# EasyEDA Pro project ProPrj_Avaota A1 八核 AIoT 开发板_2024-05-20.epro, board PCB1 (continued)
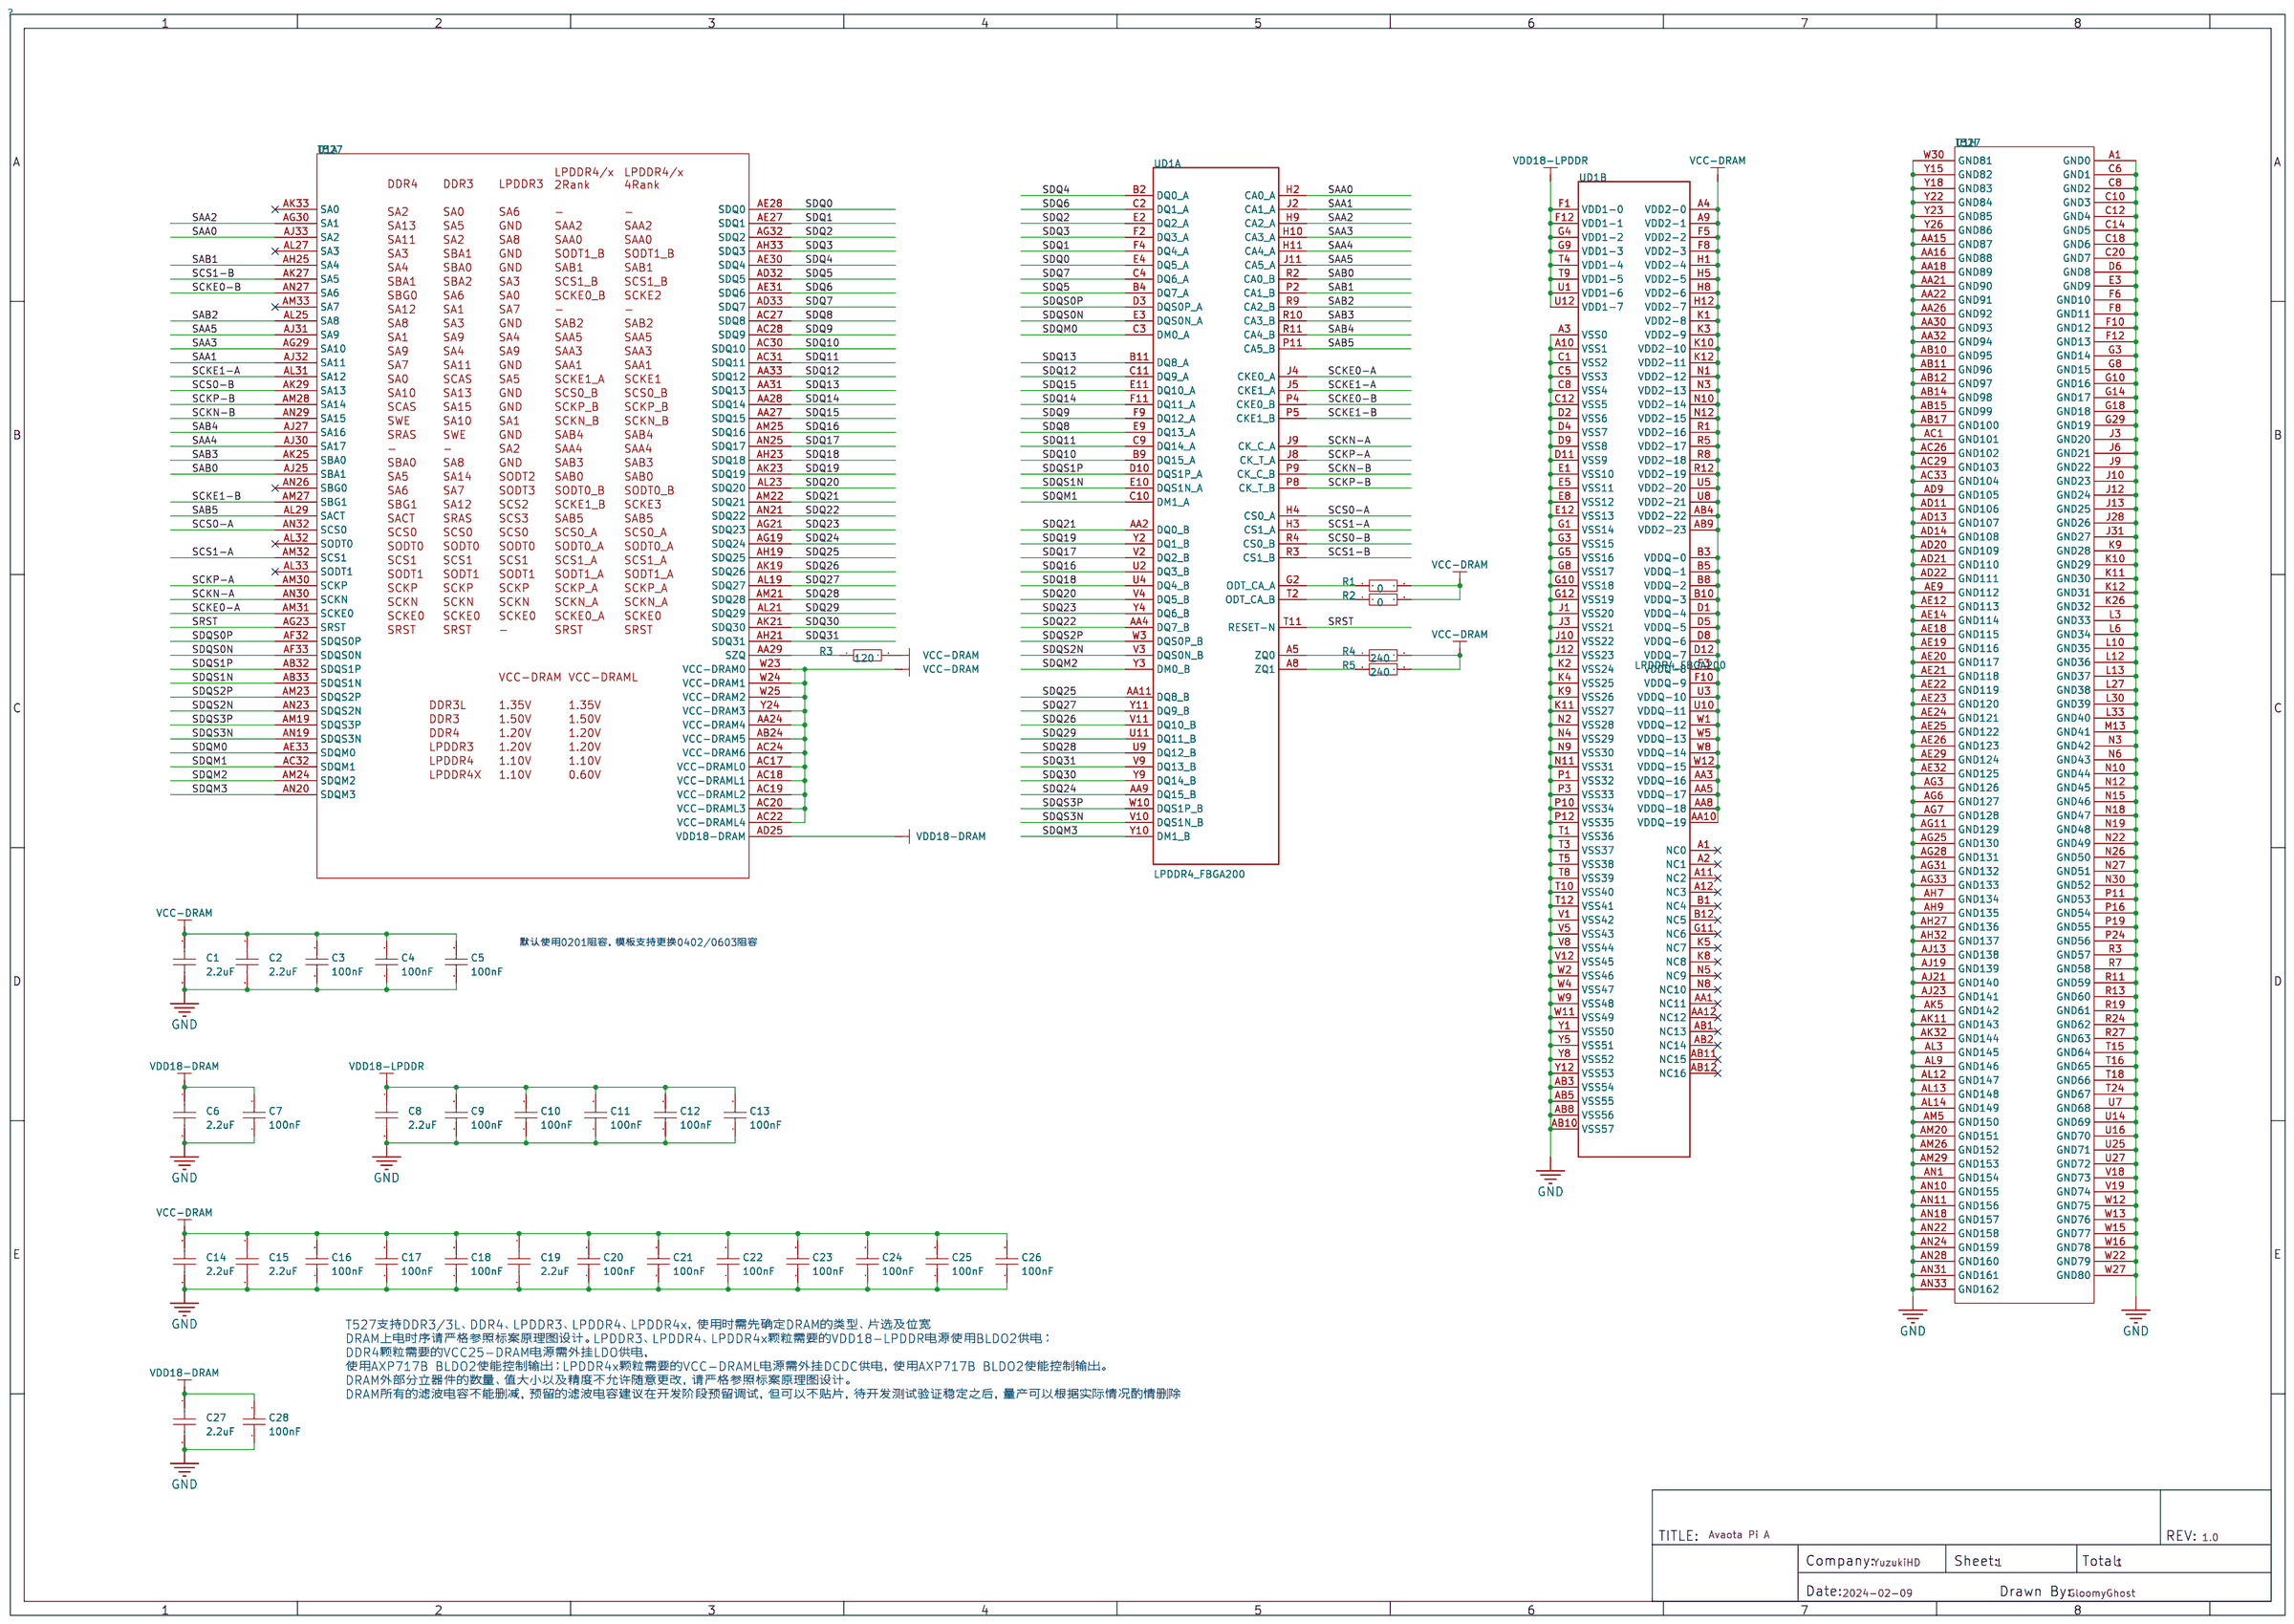
[diagram p0: schematic sheet]
## Routing (per net, layer and track width the routed paths; a pad name or vN(x,y) marks a point on that pad's centre or on a via; arc(x,y) is an arc through that point) (continued)
LCD0-RST: length 76.4
  Top Layer w0.076: 64.44,39.02 64.5,39.64 64.6,39.87 64.67,39.99 64.69,40.17 64.63,40.37 64.43,40.61
  Top Layer w0.102: v3(63.88,37.36) 63.88,38.13 64.44,38.68 64.44,39.03
  内层2 w0.127: v3(28.5,24.23) 28.5,25.81 28.09,26.21 28.09,31.9 31.27,35.08 35.99,35.08 36.3,34.77 36.3,33.83 37.85,32.28 53.47,32.28 56.26,35.08 61.01,35.08 63.3,37.36 v3(63.88,37.36)
  Bottom Layer w0.127: FPC1.33 6.79,21.78 7.42,22.4 17.86,22.4 19.68,24.23 v3(28.5,24.23)
LCD0-VSYNC: length 80.8
  Top Layer w0.127: U14.L29 v3(64.95,42.15)
  内层2 w0.127: v3(64.95,42.15) 64.61,42.15 64.36,42.39 64.36,42.73 64.07,43.03 63.7,43.03 63.32,42.65 63.32,39.4 62.86,38.94 62.86,38 60.66,35.79 55.8,35.79 53.19,33.17 42.65,33.17 41.71,34.11 40.77,34.11 40.23,33.58 39.19,33.58 38.81,33.96 38.81,34.47 38.46,34.82 37.47,34.82 36.5,35.79 30.81,35.79 27.23,32.21 27.23,26.42 26.77,25.96 26.77,24.05 25.5,22.78 24.87,22.78 23.55,21.46 v3(22.94,21.46)
  Bottom Layer w0.127: v3(22.94,21.46) 21.13,21.46 19.76,20.09 9.32,20.09 7.01,17.78 FPC1.41
LEDC: length 123.6
  Top Layer w0.076: v1(2.62,18.97) 2.62,18.97 LED2.3 ; v1(81.18,48.59) 79.2,48.59 77.39,50.39 68.69,50.39 U14.C13
  内层2 w0.076: v1(2.62,18.97) 5.61,15.98 34.26,15.98 38.86,20.57 50.09,20.57 51.26,21.74 57.12,21.74 59.64,19.23 61.87,19.23 63.3,20.65 69.19,20.65 69.8,20.04 74.52,20.04 78.13,23.65 78.13,25.22 81.69,28.78 81.69,48.08 v1(81.18,48.59)
MCSI0-CKN: length 41.4
  Top Layer w0.102: v1(71.5,52.45) 71.2,52.45 70.77,52.02 69.57,52.02 69.39,51.84 69.39,51.7 U14.A10
  Bottom Layer w0.102: FPC2.12 93.94,33.96 93.79,34.11 93.3,34.11 93.17,33.98 92.92,33.98 92.79,34.11 92.54,34.11 92.41,33.98 92.16,33.98 92.03,34.11 91.78,34.11 91.65,33.98 91.39,33.98 91.27,34.11 91.01,34.11 90.89,33.98 90.63,33.98 90.51,34.11 86.01,34.11 84.33,35.79 84.33,38.68 83.01,40.01 83.01,49.2 79.29,52.92 71.69,52.92 71.5,52.73 v1(71.5,52.45)
MCSI0-CKP: length 41.3
  Top Layer w0.102: v1(71.07,52.91) 71.07,52.61 70.68,52.22 69.49,52.22 68.94,51.67 U14.B10
  Bottom Layer w0.102: FPC2.13 93.94,34.46 93.79,34.31 86.23,34.31 84.56,35.99 84.56,38.76 83.21,40.11 83.21,49.28 79.37,53.12 71.6,53.12 71.39,52.91 v1(71.07,52.91)
MCSI0-D0N: length 42.9
  Top Layer w0.076: 71.37,51.05 70.97,50.65 U14.A12
  Top Layer w0.102: 71.37,51.05 71.55,51.23 79.12,51.23 79.73,50.62 79.73,49.25 v1(79.58,49.1)
  Bottom Layer w0.102: v1(79.58,49.1) 79.58,48.82 80.11,48.29 80.11,39.22 82.12,37.21 82.12,33.55 84.55,31.12 90.65,31.12 90.77,30.99 91.03,30.99 91.15,31.12 91.41,31.12 91.53,30.99 91.79,30.99 91.92,31.12 92.17,31.12 92.3,30.99 92.55,30.99 92.68,31.12 92.93,31.12 93.06,30.99 93.31,30.99 93.44,31.12 93.85,31.12 93.95,31.01 94.54,31.01 FPC2.6
MCSI0-D0P: length 43
  Top Layer w0.076: 71.17,51.21 70.87,50.9 69.2,50.9 U14.B12
  Top Layer w0.102: v1(80.11,49.07) 79.91,49.28 79.91,50.73 79.21,51.44 71.4,51.44 71.17,51.21
  Bottom Layer w0.102: FPC2.7 94.05,31.46 93.88,31.29 84.66,31.29 82.32,33.63 82.32,37.29 80.34,39.27 80.34,48.41 80.11,48.64 v1(80.11,49.07)
MCSI0-D1N: length 43.2
  Top Layer w0.076: 70.84,51.36 70.63,51.15 U14.B11
  Top Layer w0.102: 70.84,51.36 71.35,51.87 v1(72.09,51.87)
  Bottom Layer w0.102: FPC2.9 93.94,32.46 93.79,32.61 93.07,32.61 92.89,32.43 92.69,32.43 92.51,32.61 92.31,32.61 92.13,32.43 91.93,32.43 91.75,32.61 91.55,32.61 91.37,32.43 91.17,32.43 90.98,32.61 90.79,32.61 90.6,32.43 90.41,32.43 90.22,32.61 90.03,32.61 89.84,32.43 89.64,32.43 89.46,32.61 89.26,32.61 89.08,32.43 88.88,32.43 88.7,32.61 88.5,32.61 88.32,32.43 88.12,32.43 87.94,32.61 87.74,32.61 87.56,32.43 87.36,32.43 87.17,32.61 86.98,32.61 86.79,32.43 86.6,32.43 86.41,32.61 86.22,32.61 86.03,32.43 85.84,32.43 85.65,32.61 85,32.61 83.21,34.41 83.21,37.97 81.76,39.42 81.76,48.97 78.91,51.82 72.13,51.82 v1(72.09,51.87)
MCSI0-D1P: length 43.3
  Top Layer w0.127: U14.C11 68.43,51.13 v1(68,51.13)
  Bottom Layer w0.102: FPC2.10 93.94,32.96 93.79,32.81 85.09,32.81 83.41,34.49 83.41,38.05 81.97,39.5 81.97,49.12 79.06,52.03 72.46,52.03 72.28,52.21 71.87,52.21 70.79,51.13 v1(68,51.13)
MCSI0-D2N: length 40.8
  Top Layer w0.102: v3(66.93,51.13) 66.96,51.13 U14.E12
  Inner5 w0.102: v3(66.93,51.13) 67.51,50.55 80.35,50.55 83.34,47.57 83.34,37.61 85.34,35.61 89.72,35.61 89.87,35.46 v1(90.12,35.46)
  Bottom Layer w0.102: v1(90.12,35.46) 90.27,35.61 93.79,35.61 93.94,35.46 FPC2.15
MCSI0-D2P: length 40.8
  Top Layer w0.102: U14.D12 67.94,50.65 v3(67.46,51.13)
  Inner5 w0.102: v1(90.12,35.97) 89.87,35.97 89.72,35.81 85.42,35.81 83.54,37.69 83.54,47.65 80.43,50.76 71.85,50.76 71.72,50.89 71.47,50.89 71.34,50.76 71.09,50.76 70.96,50.89 70.7,50.89 70.58,50.76 70.32,50.76 70.2,50.89 69.94,50.89 69.82,50.76 69.56,50.76 69.44,50.89 69.18,50.89 69.05,50.76 68.8,50.76 68.67,50.89 68.42,50.89 68.29,50.76 67.63,50.76 67.46,50.93 v3(67.46,51.13)
  Bottom Layer w0.102: v1(90.12,35.97) 90.27,35.81 93.79,35.81 93.94,35.96 FPC2.16
MCSI0-D3N: length 41.1
  Top Layer w0.102: v3(67.44,52.15) 67.44,51.65 U14.E10
  Inner5 w0.102: v1(93.47,36.93) 93.21,36.93 93.05,37.09 86.09,37.09 84.71,38.47 84.71,48.18 80.98,51.92 74.12,51.92 72.64,53.39 70.43,53.39 68.57,51.53 67.85,51.53 67.61,51.77 67.61,51.97 v3(67.44,52.15)
  Bottom Layer w0.102: 94.34,37.09 93.88,37.09 93.72,36.93 v1(93.47,36.93)
MCSI0-D3P: length 41.1
  Top Layer w0.102: v3(67.94,52.15) 67.94,52.14 U14.D10
  Inner5 w0.102: v1(93.46,37.46) 93.21,37.46 93.05,37.3 86.17,37.3 84.91,38.56 84.91,48.27 81.03,52.15 74.18,52.15 72.73,53.59 70.35,53.59 69.44,52.68 69.24,52.68 69.07,52.51 69.07,52.31 68.9,52.14 68.7,52.14 68.53,51.97 68.53,51.77 68.46,51.71 67.93,51.71 67.79,51.84 67.79,51.99 v3(67.94,52.15)
  Bottom Layer w0.102: 94.34,37.3 93.88,37.3 93.72,37.46 v1(93.46,37.46)
MCSI0-MCLK: length 36.3
  Top Layer w0.152: v1(69.62,53.44) 69.44,53.62 U14.A6
  Bottom Layer w0.152: FPC2.24 94.52,40.03 84.88,40.03 84.1,40.82 84.1,49.61 79.86,53.85 70.03,53.85 v1(69.62,53.44)
MCSI0-PWDN: length 39
  Top Layer w0.076: 70.03,54.4 69.65,54.4 69.5,54.39 69.26,54.4 68.99,54.62
  Top Layer w0.102: 70.03,54.41 75.82,54.41 v1(76.28,54.86)
  Bottom Layer w0.102: FPC2.28 94.11,41.96 93.88,41.73 86.21,41.73 85.47,42.47 85.47,49.91 80.19,55.19 77.57,55.19 77.19,55.58 75.72,55.58 75.23,55.09 75.23,54.74 75.49,54.48 75.9,54.48 v1(76.28,54.86)
MCSI0-RSTN: length 35.5
  Top Layer w0.102: U14.A4 75.47,54.65 v1(75.69,54.86)
  Bottom Layer w0.102: FPC2.27 86.05,41.46 85.19,42.32 85.19,49.78 80.11,54.86 77.44,54.86 77.01,55.3 76.12,55.3 v1(75.69,54.86)
MCSI0-SCK: length 39.7
  Top Layer w0.102: U14.E8 v3(67.44,53.13)
  Inner5 w0.102: v1(93.12,38.66) 93.09,38.66 91.95,39.8 89.61,39.8 85.88,43.54 85.88,48.69 81.61,52.96 74.9,52.96 73.41,54.46 69.95,54.46 68.22,52.73 67.69,52.73 67.44,52.98 v3(67.44,53.13)
  Bottom Layer w0.102: FPC2.21 93.31,38.46 v1(93.12,38.66)
  Bottom Layer w0.152: R127.2 68.49,53.49 67.67,53.49 67.44,53.27 v3(67.44,53.13)
MCSI0-SDA: length 38.1
  Top Layer w0.102: U14.D8 v3(67.94,53.13)
  Inner5 w0.102: v1(93.14,39.24) 92.96,39.24 92.15,40.06 89.79,40.06 86.16,43.69 86.16,48.84 81.74,53.26 75.08,53.26 73.61,54.74 69.8,54.74 68.19,53.13 v3(67.94,53.13)
  Bottom Layer w0.102: v1(93.14,39.24) 93.42,38.96 FPC2.22
  Bottom Layer w0.152: R128.2 68.5,52.81 68.18,53.13 v3(67.94,53.13)
MCSI0-USER: length 36.3
  Top Layer w0.076: 70.31,54.15 70,54.15 69.75,53.9 69.19,53.9 U14.B5
  Top Layer w0.102: 70.31,54.15 76.23,54.15 v1(76.89,54.81)
  Bottom Layer w0.102: v1(76.89,54.81) 77.04,54.81 77.29,54.56 80.04,54.56 84.89,49.71 84.89,42.22 85.98,41.12 93.95,41.12 94.11,40.96 FPC2.26
MICIN3N: length 22.1
  Top Layer w0.076: 56.94,56.14 56.94,56.25 56.76,56.43 56.76,56.99 56.6,57.15 v3(56.57,57.15)
  内层2 w0.127: v3(56.57,57.15) 56.57,57.55 56.66,57.64 56.66,57.91 57.47,58.73 62.18,58.73 64.72,61.27 65.99,61.27 v1(66.12,61.39)
  Bottom Layer w0.127: C241.1 69.89,67.75 70.07,67.57 70.07,66.79 70.41,66.45 70.41,64.64 68.66,62.89 67.79,62.89 66.29,61.39 v1(66.12,61.39)
MICIN3P: length 22.7
  Top Layer w0.076: 57.1,57.23 v3(57.1,57.22) 56.94,57.06 56.94,56.53 57.19,56.28 57.19,55.89 56.94,55.64
  内层2 w0.127: v1(66.12,60.76) 65.91,60.96 64.92,60.96 62.33,58.37 57.61,58.37 57.01,57.77 57.01,57.64 57.1,57.55 v3(57.1,57.22)
  Bottom Layer w0.127: C238.1 70.48,67.75 70.3,67.57 70.3,66.88 70.64,66.55 70.64,64.55 68.65,62.56 67.92,62.56 v1(66.12,60.76)
PE0: length 58
  Top Layer w0.102: U14.E6 67.94,54.15 v3(67.94,54.15)
  Inner5 w0.102: H1.12 21.89,71.93 21.89,69.82 23.29,68.43 26.11,68.43 27.86,66.68 53.06,66.68 57.71,62.03 59.61,62.03 63.93,57.71 63.93,57.1 65.53,55.5 67.11,55.5 67.29,55.31 67.29,54.6 67.74,54.15 v3(67.94,54.15)
PE1: length 50.3
  Top Layer w0.076: 70.48,55.04 70.34,54.89 68.69,54.9 68.44,54.64
  Top Layer w0.102: 70.48,55.04 72.64,57.2 v3(72.67,57.2)
  VCC w0.102: 33.3,70.69 33.32,70.69 37.49,66.52 52.5,66.52 57.05,61.98 61.29,61.98 64.8,58.47 66.19,58.47 67.18,57.48 71.12,57.48 71.22,57.58 72.29,57.58 v3(72.67,57.2)
PE2: length 52.9
  Top Layer w0.102: U14.E5 v3(67.95,54.65)
  Inner5 w0.102: 23.14,70.69 25.04,68.78 26.24,68.78 27.99,67.03 53.26,67.03 57.94,62.36 59.77,62.36 64.26,57.86 64.26,57.25 65.68,55.83 67.23,55.83 67.59,55.47 67.59,54.87 67.78,54.68 67.93,54.68 v3(67.95,54.65)
PE3: length 55.1
  Top Layer w0.102: U14.E4 v3(67.95,55.15)
  Inner5 w0.102: v3(67.95,55.15) 67.95,55.65 67.44,56.16 65.76,56.16 64.59,57.33 64.59,58.12 60.02,62.69 58.14,62.69 53.47,67.36 28.19,67.36 26.39,69.16 25.04,69.16 24.46,69.75 24.46,72.16 24.88,72.58 25.03,72.58 H1.16
PE4: length 56.9
  Top Layer w0.076: 70.43,57.76 70.24,57.76 69.18,56.71 69.18,56 69.08,55.89 68.84,55.89 68.69,55.75 68.69,55.39 68.44,55.14
  Top Layer w0.102: v3(71.5,58.6) 71.5,58.57 70.69,57.76 70.43,57.76
  Inner5 w0.102: v3(71.5,58.6) 70.51,57.61 65.71,57.61 59.51,63.81 57.53,63.81 53.64,67.69 28.45,67.69 25.68,70.46 25.68,70.69
PE5: length 52.3
  Top Layer w0.076: 70.08,55.5 69.97,55.4 69.19,55.4 68.94,55.14
  Top Layer w0.102: 70.08,55.5 71.58,57 v3(71.58,57.2)
  VCC w0.102: H1.22 33.3,73.15 32.03,71.88 32.03,69.98 35.81,66.19 52.3,66.19 56.85,61.65 61.11,61.65 64.62,58.14 66.01,58.14 67.01,57.15 71.53,57.15 v3(71.58,57.2)
PE6: length 50.9
  Top Layer w0.076: 70.15,55.14 69.44,55.14
  Top Layer w0.102: v3(72.14,57.2) 72.14,57.12 70.15,55.14
  VCC w0.102: 30.76,70.69 30.76,70.64 35.53,65.86 52.17,65.86 56.77,61.27 60.96,61.27 64.36,57.86 65.84,57.86 66.88,56.82 71.81,56.82 72.14,57.15 v3(72.14,57.2)
PE7: length 52
  Top Layer w0.102: U14.A2 69.82,55.65 71.22,57.05 71.22,57.4 71.78,57.96 71.96,57.96 v3(72.62,58.62)
  VCC w0.102: v3(72.62,58.62) 72.62,58.34 72.11,57.84 71.07,57.84 71.02,57.79 67.36,57.79 66.37,58.78 65,58.78 61.47,62.31 57.2,62.31 52.65,66.85 37.69,66.85 34.62,69.93 34.62,72.03 35.81,73.23 H1.24
PE8: length 46.5
  Top Layer w0.076: 68.94,55.64 69.07,55.64 69.31,55.89 69.65,55.89 70,56.24
  Top Layer w0.102: 70,56.24 70.89,57.12 70.89,57.48 71.68,58.27 71.82,58.27 72.06,58.51 v3(72.06,58.6)
  VCC w0.102: v3(72.06,58.6) 71.55,58.09 67.49,58.09 66.5,59.08 65.2,59.08 61.59,62.69 57.38,62.69 52.81,67.26 38.81,67.26 35.84,70.23 35.84,70.69
PE9: length 56.6
  Top Layer w0.102: v3(70.94,58.6) 70.94,58.52 70.46,58.04 70.21,58.04 68.94,56.77 68.94,56.14
  Inner5 w0.102: v3(70.94,58.6) 70.23,57.89 66.07,57.89 59.72,64.24 57.63,64.24 53.85,68.02 28.63,68.02 26.97,69.67 26.97,71.93 28.22,73.18 H1.18
PE10: length 39.4
  Top Layer w0.076: 68.44,55.64 68.44,55.76 68.69,56.01 68.69,56.8 68.83,56.94
  Top Layer w0.115: 68.83,56.94 68.83,57.22 69.91,58.29 70.07,58.29 70.37,58.6 v3(70.41,58.6)
  Inner5 w0.102: 40.92,70.69 43.26,68.35 54.81,68.35 58.06,65.1 59.49,65.1 60.22,64.36 61.32,64.36 61.52,64.16 61.52,62.97 66.32,58.17 69.98,58.17 v3(70.41,58.6)
PE11: length 59.8
  Top Layer w0.102: v3(65.95,53.15) U14.J7
  Inner5 w0.102: 15.52,70.69 18.52,67.69 25.81,67.69 27.48,66.01 52.58,66.01 57.2,61.39 59.23,61.39 60.55,60.07 60.55,58.37 61.37,57.56 62.59,57.56 65.35,54.79 65.35,53.7 65.91,53.15 v3(65.95,53.15)
PE12: length 44.7
  Top Layer w0.102: U14.C1 68.5,56.21 68.5,57.33 v3(69.8,58.62)
  VCC w0.102: H1.26 37.13,71.98 37.13,69.39 38.86,67.67 52.96,67.67 56.79,63.83 58.95,63.83 59.72,63.07 61.77,63.07 65.41,59.44 66.67,59.44 67.72,58.39 69.57,58.39 v3(69.8,58.62)
PE13: length 55.2
  Top Layer w0.254: U14.G6 v3(66.95,54.15)
  Inner5 w0.102: v3(66.95,54.15) 66.57,54.15 66.42,54.31 66.42,54.76 66.09,55.09 65.48,55.09 62.69,57.89 61.54,57.89 60.86,58.57 60.86,60.25 59.44,61.67 57.45,61.67 52.78,66.35 27.69,66.35 25.96,68.07 23.09,68.07 20.6,70.56 20.6,70.69
PE14: length 61.7
  Top Layer w0.102: v3(64.95,53.15) U14.L7
  Inner5 w0.102: 12.98,70.69 16.36,67.31 25.63,67.31 27.25,65.68 52.41,65.68 57.01,61.09 59.06,61.09 60.25,59.89 60.25,58.17 61.16,57.25 62.48,57.25 64.31,55.42 64.31,54.33 64.57,54.08 64.57,53.53 v3(64.95,53.15)
PE15: length 63.1
  Top Layer w0.102: v3(63.95,53.15) U14.N7
  Inner5 w0.102: 10.44,70.69 10.44,70.36 13.84,66.95 25.43,66.95 27,65.38 45.03,65.38 49.63,60.78 55.68,60.78 56.29,60.17 57.73,60.17 61.52,56.39 62.86,56.39 63.96,55.3 63.96,54.28 64.31,53.92 64.31,53.34 64.12,53.15 v3(63.95,53.15)
PGAOUT0: length 6.5
  Top Layer w0.152: v3(61.95,52.65) 61.45,52.65 U14.U8
  Bottom Layer w0.076: v3(61.95,52.65) 62.56,53.26
  Bottom Layer w0.152: R26.1 60.71,56.24 60.86,56.39 62.18,56.39 62.59,55.98 62.59,53.29 62.56,53.26
PGAOUT1: length 4
  Bottom Layer w0.152: v3(61.44,51.65) 61.44,54.89 61.76,55.21 R27.1
PHYRSTB0: length 46.9
  Top Layer w0.127: U12.12 v3(70.39,21.03) 70.93,21.03 R90.2 ; U14.D16 v3(67.94,49.15)
  内层2 w0.102: v3(67.94,49.15) 69.32,49.15 70.05,49.89 72.42,49.89 72.8,50.27 74.63,50.27 74.88,50.01 76.45,50.01 79.45,47.02 79.45,29.46 73.58,23.6 73.58,21.64 72.97,21.03 72.01,21.03 72.01,21.03 v3(70.39,21.03)
PHYRSTB1: length 71.3
  Top Layer w0.102: v3(89.53,51.23) 89.53,51.26 88.62,52.17 88.47,52.17 88.04,52.6 88.04,57.99 83.85,62.18 68.41,62.18 65.94,59.71 65.94,57.3 65.58,56.95 65.58,56.29 U14.J1
  Top Layer w0.152: U13.12 88.99,20.89 R108.2
  内层2 w0.102: v3(89.53,51.23) 89.28,50.98 89.28,28.98 90.07,28.19 90.07,26.7 91.52,25.25 91.52,24.33 90.6,23.42 90.27,23.42 89.99,23.14 89.99,22.66 90.14,22.5 90.14,21.64 89.31,20.8 v3(88.65,20.8)
PMU-SCK: length 72.4
  Top Layer w0.102: U14.AN6 53.34,53.75 52.53,53.75 51.49,54.79 51.49,55.6 50.39,56.69 v1(37.36,56.69)
  Top Layer w0.152: v3(12.32,45.31) 12.75,44.88 13.03,44.88 13.13,44.98 14.78,44.98 15.09,44.68 15.09,44.06 U5.6 ; U4.52 5.51,49.43 v3(5.16,49.07) 5.18,49.05 R11.2
  Bottom Layer w0.102: v1(37.36,56.69) 36.55,56.69 35.86,56.01 14.4,56.01 12.47,54.08 12.47,50.06 11.1,48.69 6.26,48.69 5.65,49.3 5.38,49.3 v3(5.16,49.07) 5.16,48.9 5.82,48.23 5.82,46.05 6.93,44.93 11.94,44.93 v3(12.32,45.31)
PMU-SDA: length 75.2
  Top Layer w0.076: 53.43,54.14 53.44,54.14
  Top Layer w0.102: U4.51 5.77,49.81 6.17,49.81 6.25,49.73 6.25,49.4 5.71,48.86 R12.2 ; v1(36.75,57.07) 37.57,57.07 37.72,56.92 50.52,56.92 51.71,55.73 51.71,54.86 52.63,53.95 53.25,53.95 53.43,54.14 U14.AN5
  Top Layer w0.152: v3(12.85,45.31) 12.9,45.26 14.88,45.26 15.45,44.7 U5.5 ; v3(5.13,49.61) 5.35,49.83 U4.51
  Bottom Layer w0.102: v3(12.85,45.31) 12.24,44.7 6.78,44.7 5.56,45.92 5.56,48.16 4.8,48.92 4.8,49.28 v3(5.13,49.61) 5.71,49.61 6.35,48.97 10.97,48.97 12.24,50.24 12.24,55.04 13.51,56.31 35.66,56.31 36.42,57.07 v1(36.75,57.07)
PS: length 26.6
  Top Layer w0.203: v3(10.95,54) 11.12,53.83 U4.25 11.92,53.83 12.6,54.51 C12.1 ; v3(18.19,41.81) 18.19,42.47 18.04,42.61 U5.17 ; v3(17.65,44.17) 17.66,44.16 U5.20 ; v3(9.32,54.15) 9.46,54.3 U4.31 ; v3(9.58,49.53) 9.46,49.42 U4.9 ; v3(8.99,55.22) 9.06,55.15 U4.32 9.06,54.43 v3(8.79,54.15) ; U5.2 16.65,44.96 v3(16.79,45.1) ; v3(10.95,52.02) 11.14,51.83 U4.20 12.85,51.83 C17.1 ; C55.1 12.47,48.97 12.17,49.28 12.17,49.63 11.97,49.83 U4.15 11.21,49.83 v3(11.02,50.01)
  Top Layer w0.406: C284.2 17.84,39.92 18.19,40.26 v3(18.19,40.85) v3(18.19,41.34) v3(18.19,41.81)
  Top Layer w0.508: C284.2 C283.2
  Bottom Layer w0.102: v3(11.02,50.01) C46.1
  Bottom Layer w0.381: 11.1,53.31 11.1,53.85 v3(10.95,54) ; v3(9.58,49.53) 9.68,49.43 C30.1 ; 11.1,52.43 11.1,52.17 v3(10.95,52.02)
  Bottom Layer w0.508: C79.2 C29.1 5.79,52.83 5.82,52.86 v3(6.38,52.86) 6.5,52.98 C26.1 ; C79.2 6.13,51.05 v3(6.38,50.81) ; C79.2 6.02,51.28 v3(6.38,51.28) ; v3(8.79,54.15) 8.79,55.13 C286.2 ; C285.2 9.32,55.28 v3(9.32,54.15) ; 11.05,51.35 10.95,51.45 v3(10.95,52.02) ; 5.89,52.38 v3(6.38,52.38)
  vias: v3(18.06,45.18)
PWRON: length 19.1
  Top Layer w0.102: v3(8.66,49.5) 8.26,49.11 U4.6 8.26,48.19 C11.1
  Top Layer w0.152: v1(23.65,48.54) 23.65,49.05 23.9,49.3 24.33,49.3 C97.2 24.36,49.33 R23.2
  内层4 w0.152: v1(23.65,48.54) 23.24,48.95 11,48.95 10.85,49.1 9.07,49.1 v3(8.66,49.5)
RF: length 3.7
  Top Layer w0.127: R72.1 C244.2 15.68,64.17 15.72,64.2
RGMII0-CLKIN: length 47.9
  Top Layer w0.076: 70.56,48.18 70.33,48.18 70.26,48.11 69.99,48.11 69.78,47.9 68.69,47.89 68.44,48.14
  Top Layer w0.102: 70.56,48.18 72.95,48.18 v3(74.04,49.28)
  Top Layer w0.127: U12.35 v3(63.35,22.63)
  内层2 w0.102: v3(63.35,22.63) 63.52,22.45 71.7,22.45 72.31,23.06 72.31,24 78.51,30.2 78.51,46.51 75.84,49.17 74.14,49.17 v3(74.04,49.28)
RGMII0-MDC: length 43.5
  Top Layer w0.076: 68.44,48.64 68.69,48.39 69.04,48.39 69.14,48.3 69.67,48.3 69.9,48.53 ; 69.9,48.53 69.9,48.54
  Top Layer w0.102: v3(72.85,49.3) 72.24,48.69 70.04,48.69 69.88,48.51 ; v3(72.42,21.49) 72.35,21.43 U12.13
  内层2 w0.102: v3(72.85,49.3) 73.2,49.66 74.24,49.66 74.47,49.43 76.05,49.43 78.82,46.66 78.82,29.97 72.72,23.88 72.72,21.79 v3(72.42,21.49)
RGMII0-MDIO: length 44.1
  Top Layer w0.076: 71.98,49 71.91,48.92 69.22,48.92 U14.B16
  Top Layer w0.102: 71.98,49 v3(72.29,49.3)
  Top Layer w0.127: v3(73.18,21.82) 72.72,21.82 72.26,22.28 71.23,22.28 70.93,21.98 R83.2 70.91,21.83 U12.14
  内层2 w0.102: v3(72.29,49.3) 72.92,49.94 74.47,49.94 74.7,49.71 76.25,49.71 79.12,46.84 79.12,29.69 73.1,23.67 73.1,21.9 v3(73.18,21.82)
RGMII0-RXCK: length 42.7
  Top Layer w0.076: v3(70.66,49.33) 70.29,49.7 69.84,49.7 69.54,49.4 69.34,49.4 69.1,49.64 68.94,49.64
  Top Layer w0.127: U12.27 66,26.35 66.19,26.54 v3(66.19,26.76)
  内层2 w0.102: v3(66.19,26.76) 66.42,26.53 66.42,25.2 67.39,24.23 70.51,24.23 77.27,30.99 77.27,45.92 75.16,48.03 71.96,48.03 v3(70.66,49.33)
RGMII0-RXCTL: length 42.2
  Top Layer w0.127: U14.D18 v3(67.94,48.15) ; v3(66.75,26.76) 66.75,26.49 66.4,26.14 U12.26
  内层2 w0.102: v3(66.75,26.76) 66.75,25.3 67.49,24.56 70.28,24.56 76.91,31.19 76.91,45.87 75.11,47.68 71.75,47.68 70.79,48.64 68.43,48.64 v3(67.94,48.15)
RGMII0-RXD0: length 41.5
  Top Layer w0.127: U12.25 66.8,25.96 67.34,26.49 v3(67.34,26.76) ; U14.E18 v3(67.44,48.15)
  内层2 w0.102: v3(67.44,48.15) 67.44,47.93 67.59,47.78 68.1,47.78 68.61,48.29 70.69,48.29 71.6,47.37 74.93,47.37 76.58,45.72 76.58,31.39 70.03,24.84 67.64,24.84 67.11,25.37 67.11,26.39 67.34,26.62 v3(67.34,26.76)
RGMII0-RXD1: length 40.5
  Top Layer w0.127: U14.F18 v3(66.94,48.15) ; U12.24 67.2,25.8 67.96,26.56 v3(67.96,26.76)
  内层2 w0.102: v3(67.96,26.76) 67.46,26.26 67.46,25.53 67.87,25.12 69.75,25.12 76.25,31.62 76.25,45.57 74.78,47.04 71.48,47.04 70.56,47.96 68.76,47.96 68.34,47.54 67.42,47.54 66.94,48.02 v3(66.94,48.15)
RGMII0-RXD2: length 48.8
  Top Layer w0.127: 67.6,24.93 67.6,25.64 68.55,26.59 v3(68.55,26.76) ; U14.D14 v3(67.94,50.15)
  内层4 w0.102: v3(67.94,50.15) 68.06,50.15 70.03,48.18 78.21,48.18 80.57,45.82 80.57,28.8 76.78,25.02 69.77,25.02 68.55,26.24 v3(68.55,26.76)
RGMII0-RXD3: length 48.1
  Top Layer w0.127: v3(69.19,26.76) 69.19,26.67 68,25.48 U12.22 ; v3(67.44,50.15) U14.E14
  内层4 w0.102: v3(69.19,26.76) 68.94,26.5 68.94,26.29 69.93,25.3 76.68,25.3 80.29,28.91 80.29,45.64 78.03,47.9 69.9,47.9 68.05,49.76 67.84,49.76 v3(67.44,50.15)
RGMII0-TXCK: length 50.4
  Top Layer w0.102: v3(66.42,50.17) 66.42,50.62 U14.G12 ; U12.20 69.57,24.23 69.82,24.49 72.29,24.49 73.03,23.75 74.7,23.75 75.26,24.31 76.45,24.31 v3(76.84,23.93)
  内层2 w0.076: v3(66.42,50.17) 66.78,50.52 68.07,50.52 68.43,50.17 68.94,50.17 69.04,50.27
  内层2 w0.102: v3(76.84,23.93) 76.84,25.17 80.44,28.78 80.44,47.52 76.99,50.98 75.41,50.98 75.16,51.23 72.42,51.23 71.91,50.72 69.49,50.72 69.04,50.27
RGMII0-TXCTL: length 48.6
  Top Layer w0.102: U12.19 69.62,23.83 69.98,24.18 72.09,24.18 72.85,23.42 74.83,23.42 75.31,23.9 v3(76.2,23.9)
  Top Layer w0.127: U14.F14 v3(66.94,50.15)
  内层2 w0.102: v3(66.94,50.15) 67.36,49.73 69.01,49.73 69.7,50.42 72.03,50.42 72.52,50.9 74.96,50.9 75.21,50.65 76.81,50.65 80.11,47.35 80.11,29.03 76.45,25.37 76.45,24.16 v3(76.2,23.9)
RGMII0-TXD0: length 47.5
  Top Layer w0.102: v3(75.62,23.5) 75.46,23.5 75.03,23.06 72.75,23.06 71.98,23.83 70.16,23.83 69.76,23.43 U12.18
  Top Layer w0.127: U14.E16 v3(67.44,49.15)
  内层2 w0.102: v3(75.62,23.5) 75.62,23.9 76.1,24.38 76.1,25.55 79.78,29.24 79.78,47.19 76.63,50.34 75.03,50.34 74.78,50.6 72.62,50.6 72.19,50.17 69.9,50.17 69.24,49.5 67.79,49.5 v3(67.44,49.15)
RGMII0-TXD1: length 39.9
  Top Layer w0.076: 70.43,48.44 70.08,48.44 69.71,48.07 69.02,48.07 68.94,48.14
  Top Layer w0.102: v3(73.46,49.3) 72.59,48.44 70.43,48.44 ; U12.17 70.07,23.03 v3(70.16,23.11)
  内层2 w0.102: v3(73.46,49.3) 73.86,48.9 75.64,48.9 78.23,46.3 78.23,30.4 71.96,24.13 71.96,23.17 71.65,22.86 70.41,22.86 v3(70.16,23.11)
RGMII0-TXD2: length 37.5
  Top Layer w0.076: v3(71.2,49.33) 70.87,49.66 70.62,49.66 70.36,49.91 69.71,49.91 69.44,49.64
  Top Layer w0.102: v3(70.97,23.34) 70.25,22.63 U12.16
  内层2 w0.102: v3(71.2,49.33) 72.19,48.34 75.29,48.34 77.6,46.03 77.6,30.79 71.2,24.38 71.2,23.57 v3(70.97,23.34)
RGMII0-TXD3: length 39
  Top Layer w0.102: v3(71.73,49.33) 71.2,49.86 70.76,49.86 70.51,50.11 68.97,50.11 U14.B13 ; U12.15 70.51,22.23 71.55,23.27 v3(71.55,23.34)
  内层2 w0.102: v3(71.55,23.34) 71.55,24.23 77.93,30.61 77.93,46.13 75.44,48.62 72.44,48.62 v3(71.73,49.33)
RGMII1-CLKIN: length 59
  Top Layer w0.076: 67.44,55.64 67.7,55.91 67.7,57.71 68.3,58.3 68.3,58.32
  Top Layer w0.102: 68.3,58.32 69.8,59.82 81.64,59.82 84.07,57.38 84.07,55.32 84.28,55.12 84.28,54.36 83.97,54.05 83.49,54.05 v3(83.16,53.72)
  Top Layer w0.152: U13.35 v3(81.53,22.49)
  内层2 w0.102: v3(83.16,53.72) 83.16,52.12 83.74,51.54 83.74,48.34 84.56,47.52 84.56,27.89 83.87,27.2 83.87,26.44 84.25,26.06 84.25,25.21 v3(81.53,22.49)
RGMII1-MDC: length 71.2
  Top Layer w0.076: 66.24,58.56 66.18,58.49 66.18,58.09 66.27,58.01 66.27,56.66 66.01,56.4 66.01,55.71 65.94,55.64
  Top Layer w0.102: v3(88.95,51.23) 88.52,51.66 88.44,51.66 87.68,52.43 87.68,57.79 83.59,61.87 68.63,61.87 66.25,59.5 66.25,58.55 ; v3(90.45,22.94) 90.12,22.61 90.12,21.64 89.77,21.29 U13.13
  内层2 w0.102: v3(88.95,51.23) 89.2,51.49 89.26,51.49 89.41,51.64 89.66,51.64 89.92,51.38 89.92,51.05 89.61,50.75 89.61,29.11 90.37,28.35 90.37,26.95 91.9,25.43 91.9,24.13 90.7,22.94 v3(90.45,22.94)
RGMII1-MDIO: length 68
  Top Layer w0.076: 66.55,59.01 66.55,59.15 ; 65.94,55.14 66.19,55.4 66.19,56.32 66.43,56.56 66.43,58.33 66.51,58.41 66.51,58.98 66.55,59.01
  Top Layer w0.102: 66.55,59.15 66.55,59.27 68.86,61.57 83.34,61.57 87.33,57.58 87.33,52.27 v3(88.37,51.23) ; v3(89.33,22.48) 89.04,22.19 R101.2
  Top Layer w0.152: R101.2 89.04,21.69 U13.14
  内层2 w0.102: v3(89.33,22.48) 89.71,22.86 89.71,23.42 90.04,23.75 90.37,23.75 91.11,24.49 91.11,25.12 89.66,26.57 89.66,28.14 88.9,28.91 88.9,50.7 v3(88.37,51.23)
RGMII1-RXCK: length 60.2
  Top Layer w0.102: U14.J5 v3(65.95,54.15)
  Top Layer w0.152: v3(84.28,26.61) 84.16,26.49 84.16,24.79
  内层2 w0.102: v3(65.95,54.15) 66.12,54.15 66.7,53.57 67.26,53.57 67.56,53.87 67.56,58.83 68.53,59.79 82.17,59.79 84.33,57.63 84.33,55.93 83.74,55.35 83.36,55.35 82.98,54.97 82.98,54.46 83.57,53.87 83.57,52.27 84.1,51.74 84.1,48.49 84.88,47.7 84.88,27.63 84.28,27.03 v3(84.28,26.61)
RGMII1-RXCTL: length 54.5
  Top Layer w0.076: 67.44,56.54 67.44,57.74 67.75,58.05
  Top Layer w0.102: v3(84.02,52.48) 84.02,53.65 84.63,54.25 84.63,55.35 84.45,55.52 84.45,57.56 81.91,60.1 69.7,60.1 67.76,58.15 67.76,58.05 ; 67.44,56.15 67.44,56.54
  Top Layer w0.152: v3(84.81,26.61) 84.81,26.34 84.56,26.09 84.56,24.79
  内层2 w0.102: v3(84.02,52.48) 84.48,52.02 84.48,48.64 85.19,47.93 85.19,27.46 84.81,27.08 v3(84.81,26.61)
RGMII1-RXD0: length 57.5
  Top Layer w0.076: 67.94,55.64 68.19,55.9 68.19,57.42 68.4,57.63
  Top Layer w0.102: v3(83.39,54.64) 83.39,55.09 83.29,55.19 83.03,55.19 82.93,55.29 82.93,55.47 83.03,55.57 83.29,55.57 83.39,55.67 83.39,55.85 83.29,55.95 83.03,55.95 82.93,56.05 82.93,56.23 83.03,56.33 83.29,56.33 83.39,56.44 83.39,57.05 81.23,59.21 81.03,59.21 80.93,59.11 80.93,58.85 80.83,58.75 80.65,58.75 80.55,58.85 80.55,59.11 80.45,59.21 80.27,59.21 80.17,59.11 80.17,58.85 80.06,58.75 79.89,58.75 79.79,58.85 79.79,59.11 79.68,59.21 79.51,59.21 79.4,59.11 79.4,58.85 79.3,58.75 79.12,58.75 79.02,58.85 79.02,59.11 78.92,59.21 78.74,59.21 78.64,59.11 78.64,58.85 78.54,58.75 78.36,58.75 78.26,58.85 78.26,59.11 78.16,59.21 77.98,59.21 77.88,59.11 77.88,58.85 77.78,58.75 77.6,58.75 77.5,58.85 77.5,59.11 77.4,59.21 77.22,59.21 77.12,59.11 77.12,58.85 77.02,58.75 76.84,58.75 76.74,58.85 76.74,59.11 76.64,59.21 69.9,59.21 68.4,57.71 68.4,57.63
  Top Layer w0.152: 84.96,24.79 84.96,25.9 85.37,26.31 v3(85.37,26.61)